# EasyEDA Pro project BCI_nikki_corp_ver_1.0.eprj, schematic BCI_ADS1299

## Sheets
1 ESP and Power: Board Name: CK-C3-Mini-085-4LY; Create Date: 2025-02-17; Page Name: ESP and Power; Project Name: BCI_nikki_corp_Rasp_ver_2.0; Schematic Name: BCI_ADS1299; Update Date: 2025-05-24; Company: Designed by --nikki--; Page Size: A4; Version: V3.0
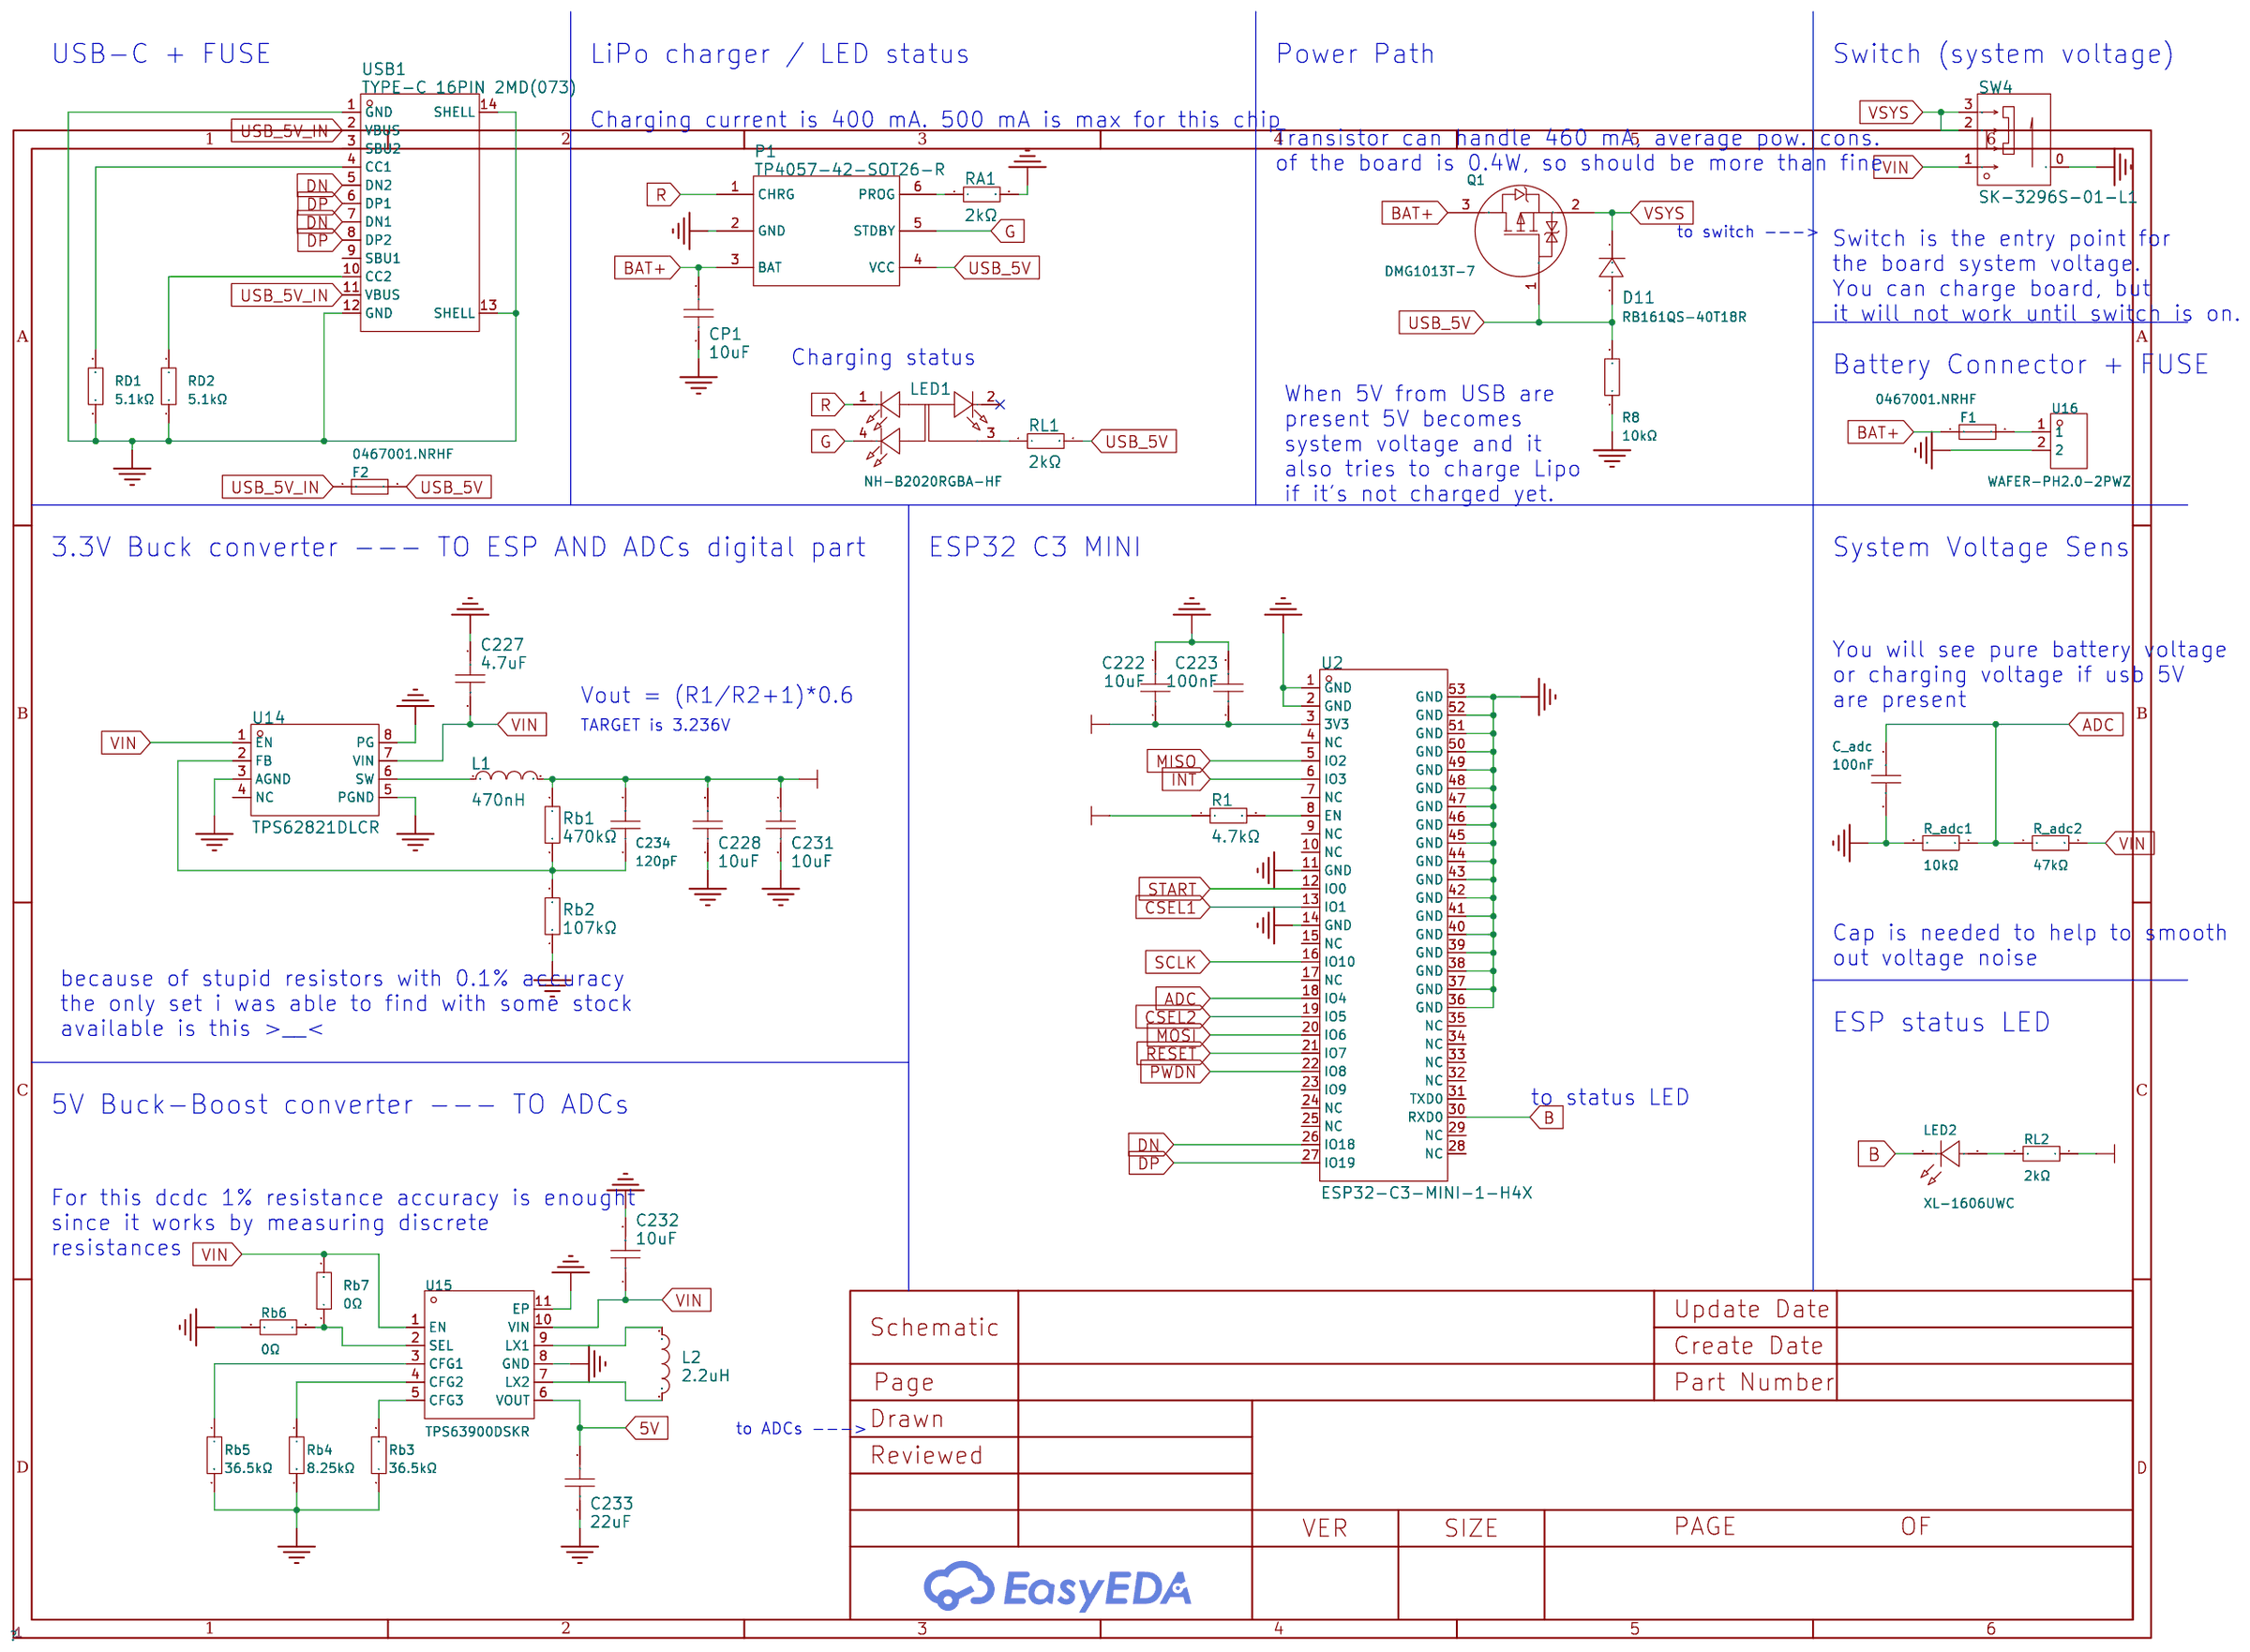
[diagram p0: ESP and Power]
2 ADCs: Create Date: 2025-05-08; Page Name: ADCs; Update Date: 2025-05-08
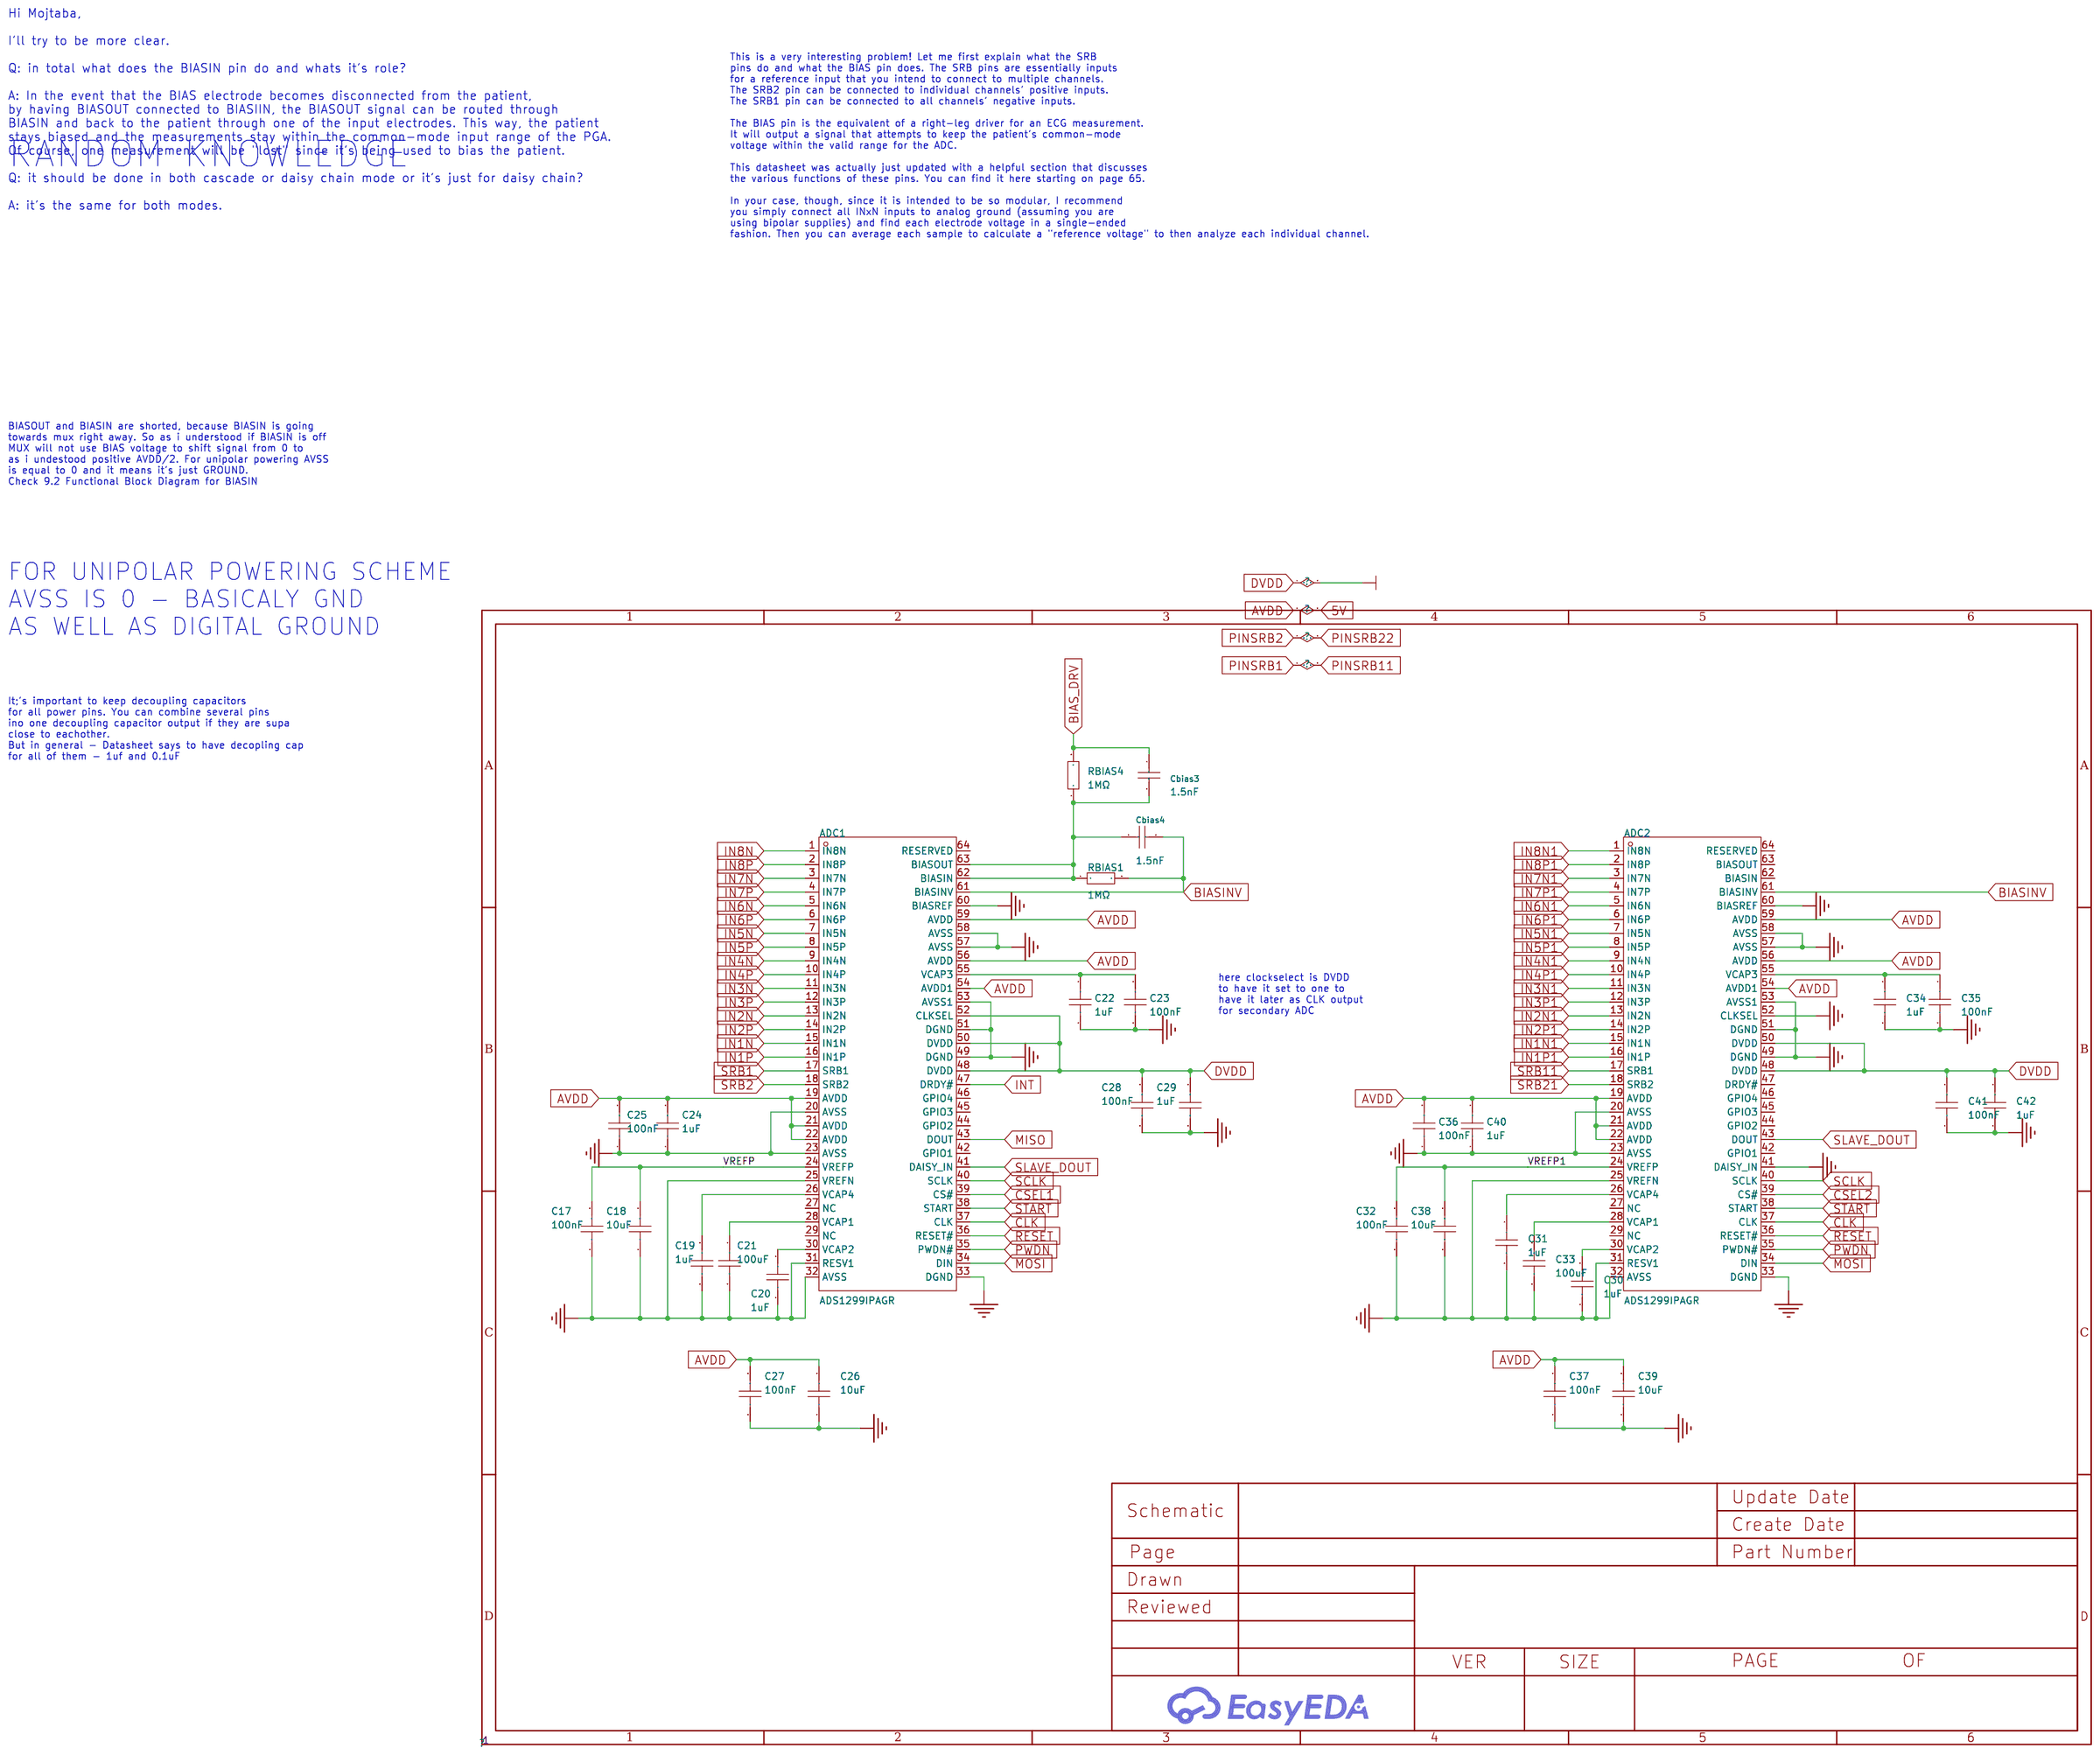
[diagram p1: ADCs]
3 ADC pins and connector: Create Date: 2025-05-08; Page Name: ADC pins and connector; Update Date: 2025-05-08
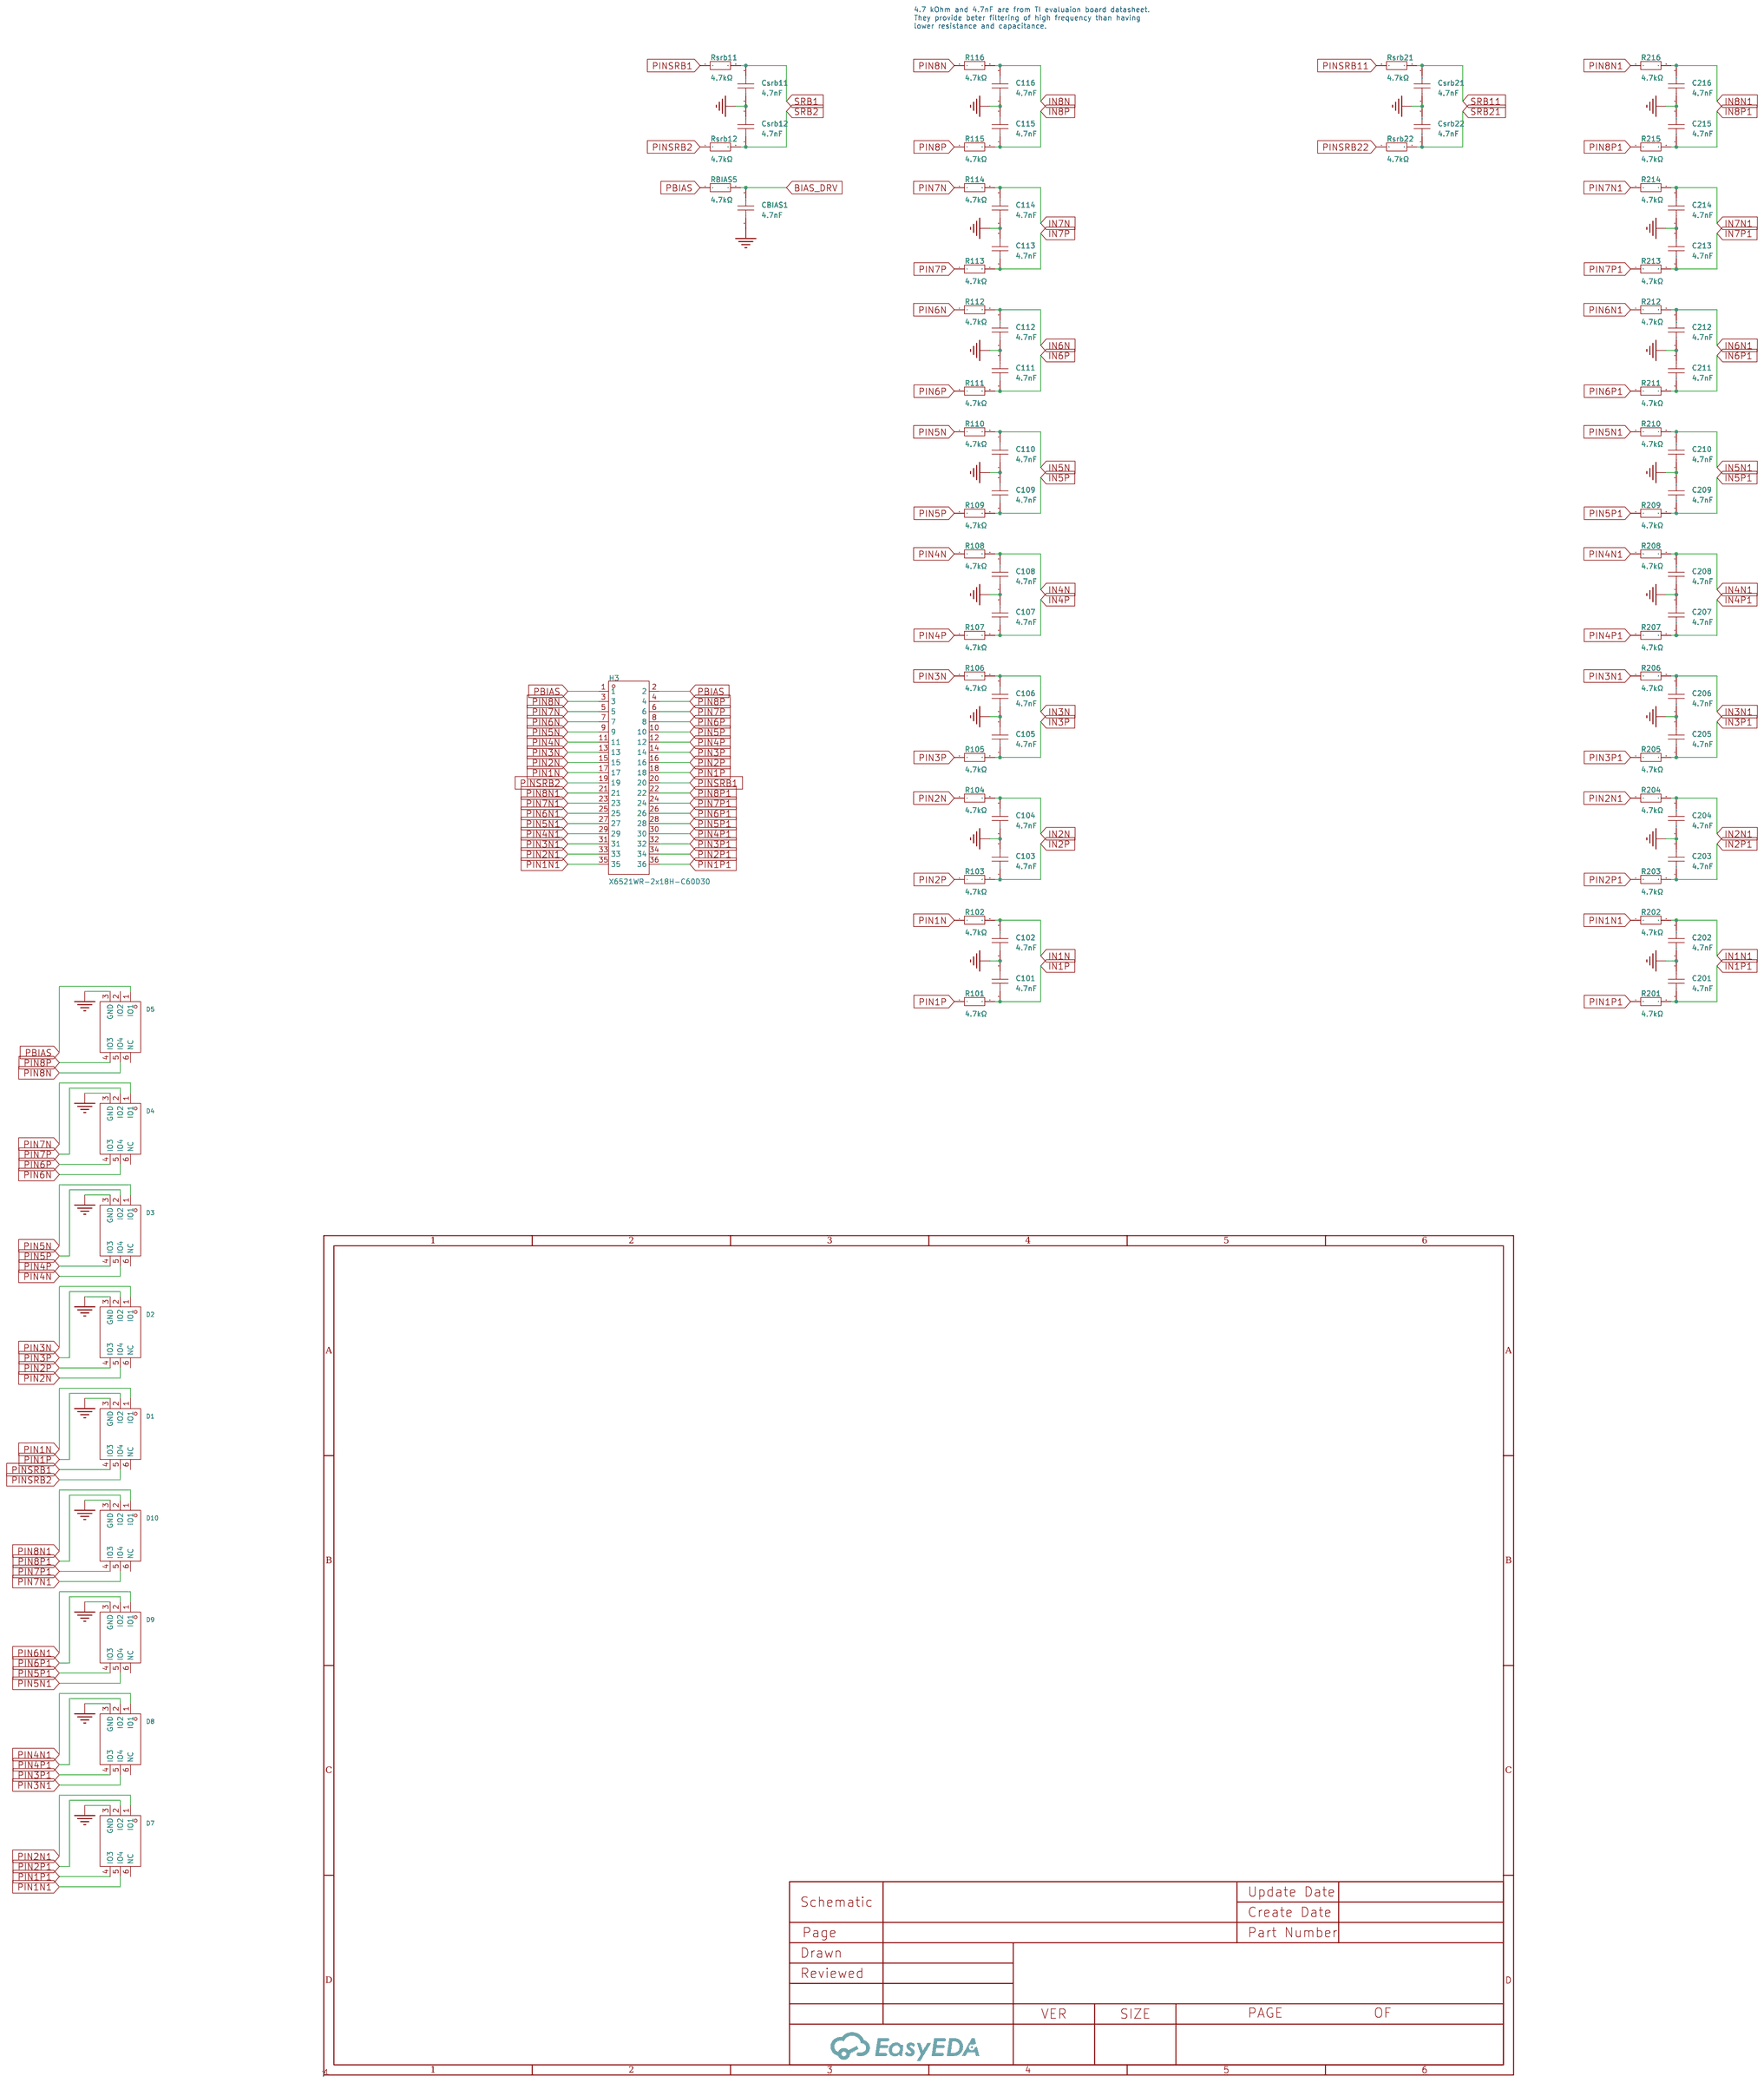
[diagram p2: ADC pins and connector]

## Parts
sheet ADC pins and connector
C101  4.7nF  [C0402 small]
C102  4.7nF  [C0402 small]
C103  4.7nF  [C0402 small]
C104  4.7nF  [C0402 small]
C105  4.7nF  [C0402 small]
C106  4.7nF  [C0402 small]
C107  4.7nF  [C0402 small]
C108  4.7nF  [C0402 small]
C109  4.7nF  [C0402 small]
C110  4.7nF  [C0402 small]
C111  4.7nF  [C0402 small]
C112  4.7nF  [C0402 small]
C113  4.7nF  [C0402 small]
C114  4.7nF  [C0402 small]
C115  4.7nF  [C0402 small]
C116  4.7nF  [C0402 small]
C201  4.7nF  [C0402 small]
C202  4.7nF  [C0402 small]
C203  4.7nF  [C0402 small]
C204  4.7nF  [C0402 small]
C205  4.7nF  [C0402 small]
C206  4.7nF  [C0402 small]
C207  4.7nF  [C0402 small]
C208  4.7nF  [C0402 small]
C209  4.7nF  [C0402 small]
C210  4.7nF  [C0402 small]
C211  4.7nF  [C0402 small]
C212  4.7nF  [C0402 small]
C213  4.7nF  [C0402 small]
C214  4.7nF  [C0402 small]
C215  4.7nF  [C0402 small]
C216  4.7nF  [C0402 small]
CBIAS1  4.7nF  [C0402 small]
Csrb11  4.7nF  [C0402 small]
Csrb12  4.7nF  [C0402 small]
Csrb21  4.7nF  [C0402 small]
Csrb22  4.7nF  [C0402 small]
D1  TPD4E1B06DCKR  [SC-70-6_L2.2-W1.3-P0.65-LS2.1-BL]
D2  TPD4E1B06DCKR  [SC-70-6_L2.2-W1.3-P0.65-LS2.1-BL]
D3  TPD4E1B06DCKR  [SC-70-6_L2.2-W1.3-P0.65-LS2.1-BL]
D4  TPD4E1B06DCKR  [SC-70-6_L2.2-W1.3-P0.65-LS2.1-BL]
D5  TPD4E1B06DCKR  [SC-70-6_L2.2-W1.3-P0.65-LS2.1-BL]
D7  TPD4E1B06DCKR  [SC-70-6_L2.2-W1.3-P0.65-LS2.1-BL]
D8  TPD4E1B06DCKR  [SC-70-6_L2.2-W1.3-P0.65-LS2.1-BL]
D9  TPD4E1B06DCKR  [SC-70-6_L2.2-W1.3-P0.65-LS2.1-BL]
D10  TPD4E1B06DCKR  [SC-70-6_L2.2-W1.3-P0.65-LS2.1-BL]
H3  X6521WR-2x18H-C60D30  [HDR-TH_36P-P2.54-H-M-R2-C18-S2.54]
R101  4.7kΩ  [R0402]
R102  4.7kΩ  [R0402]
R103  4.7kΩ  [R0402]
R104  4.7kΩ  [R0402]
R105  4.7kΩ  [R0402]
R106  4.7kΩ  [R0402]
R107  4.7kΩ  [R0402]
R108  4.7kΩ  [R0402]
R109  4.7kΩ  [R0402]
R110  4.7kΩ  [R0402]
R111  4.7kΩ  [R0402]
R112  4.7kΩ  [R0402]
R113  4.7kΩ  [R0402]
R114  4.7kΩ  [R0402]
R115  4.7kΩ  [R0402]
R116  4.7kΩ  [R0402]
R201  4.7kΩ  [R0402]
R202  4.7kΩ  [R0402]
R203  4.7kΩ  [R0402]
R204  4.7kΩ  [R0402]
R205  4.7kΩ  [R0402]
R206  4.7kΩ  [R0402]
R207  4.7kΩ  [R0402]
R208  4.7kΩ  [R0402]
R209  4.7kΩ  [R0402]
R210  4.7kΩ  [R0402]
R211  4.7kΩ  [R0402]
R212  4.7kΩ  [R0402]
R213  4.7kΩ  [R0402]
R214  4.7kΩ  [R0402]
R215  4.7kΩ  [R0402]
R216  4.7kΩ  [R0402]
RBIAS5  4.7kΩ  [R0402]
Rsrb11  4.7kΩ  [R0402]
Rsrb12  4.7kΩ  [R0402]
Rsrb21  4.7kΩ  [R0402]
Rsrb22  4.7kΩ  [R0402]
sheet ADCs
ADC1  ADS1299IPAGR  [TQFP-64_L10.0-W10.0-P0.50-LS12.0-TL]
ADC2  ADS1299IPAGR  [TQFP-64_L10.0-W10.0-P0.50-LS12.0-TL]
C17  100nF  [C0603]
C18  10uF  [C0603]
C19  1uF  [C0603]
C20  1uF  [C0603]
C21  100uF  [C1210]
C22  1uF  [C0603]
C23  100nF  [C0603]
C24  1uF  [C0603]
C25  100nF  [C0603]
C26  10uF  [C0603]
C27  100nF  [C0603]
C28  100nF  [C0603]
C29  1uF  [C0603]
C30  1uF  [C0603]
C31  1uF  [C0603]
C32  100nF  [C0603]
C33  100uF  [C1210]
C34  1uF  [C0603]
C35  100nF  [C0603]
C36  100nF  [C0603]
C37  100nF  [C0603]
C38  10uF  [C0603]
C39  10uF  [C0603]
C40  1uF  [C0603]
C41  100nF  [C0603]
C42  1uF  [C0603]
Cbias3  1.5nF  [C0402 small]
Cbias4  1.5nF  [C0402 small]
RBIAS1  1MΩ  [C0402 small]
RBIAS4  1MΩ  [C0402 small]
sheet ESP and Power
C222  10uF  [C0603]
C223  100nF  [C0603]
C227  4.7uF  [C0603]
C228  10uF  [C0603]
C231  10uF  [C0603]
C232  10uF  [C0603]
C233  22uF  [C0603]
C234  120pF  [C0402 small]
C_adc  100nF  [C0402 small]
CP1  10uF  [C0603]
D11  RB161QS-40T18R  [X2-DFN1006-2_L1.0-W0.6-P0.65-RD]
F1  0467001.NRHF  [F0603]
F2  0467001.NRHF  [F0603]
L1  470nH  [L1008]
L2  2.2uH  [L1008]
LED1  NH-B2020RGBA-HF  [LED-ARRAY-SMD_4P-L2.1-W2.1-TL_NH-B2020RGBA]
LED2  XL-1606UWC  [LED-SMD_L1.7-W0.6-RD]
P1  TP4057-42-SOT26-R  [SOT-23-6_L2.9-W1.6-P0.95-LS2.8-BL]
Q1  DMG1013T-7  [SC-75-3_L1.6-W0.8-P1.00-LS1.6-BR]
R1  4.7kΩ  [R0402]
R8  10kΩ  [R0402]
R_adc1  10kΩ  [C0402 small]
R_adc2  47kΩ  [C0402 small]
RA1  2kΩ  [R0402]
Rb1  470kΩ  [C0402 small]
Rb2  107kΩ  [C0402 small]
Rb3  36.5kΩ  [C0402 small]
Rb4  8.25kΩ  [C0402 small]
Rb5  36.5kΩ  [C0402 small]
Rb6  0Ω  [C0402 small]
Rb7  0Ω  [C0402 small]  (no BOM)
RD1  5.1kΩ  [R0402]
RD2  5.1kΩ  [R0402]
RL1  2kΩ  [R0402]
RL2  2kΩ  [R0402]
SW4  SK-3296S-01-L1  [SW-SMD_3P-P1.50_L2.7-W6.6]
U2  ESP32-C3-MINI-1-H4X  [WIFIM-SMD_ESP32-C3-MINI-1]
U14  TPS62821DLCR  [VSON-8_L2.0-W1.5-P0.50-BL]
U15  TPS63900DSKR  [WSON-10_L2.5-W2.5-W0.50-TL-EP]
U16  WAFER-PH2.0-2PWZ  [CONN-TH_2P-P2.00_GP01-2001WR-2P]
USB1  TYPE-C 16PIN 2MD(073)  [USB-C-SMD_TYPE-C-6PIN-2MD-073]
